# Altium schematic sheet Intel16_UNI3_Q2.SchDoc
size A3; SheetNumber: 10; SheetTotal: 15
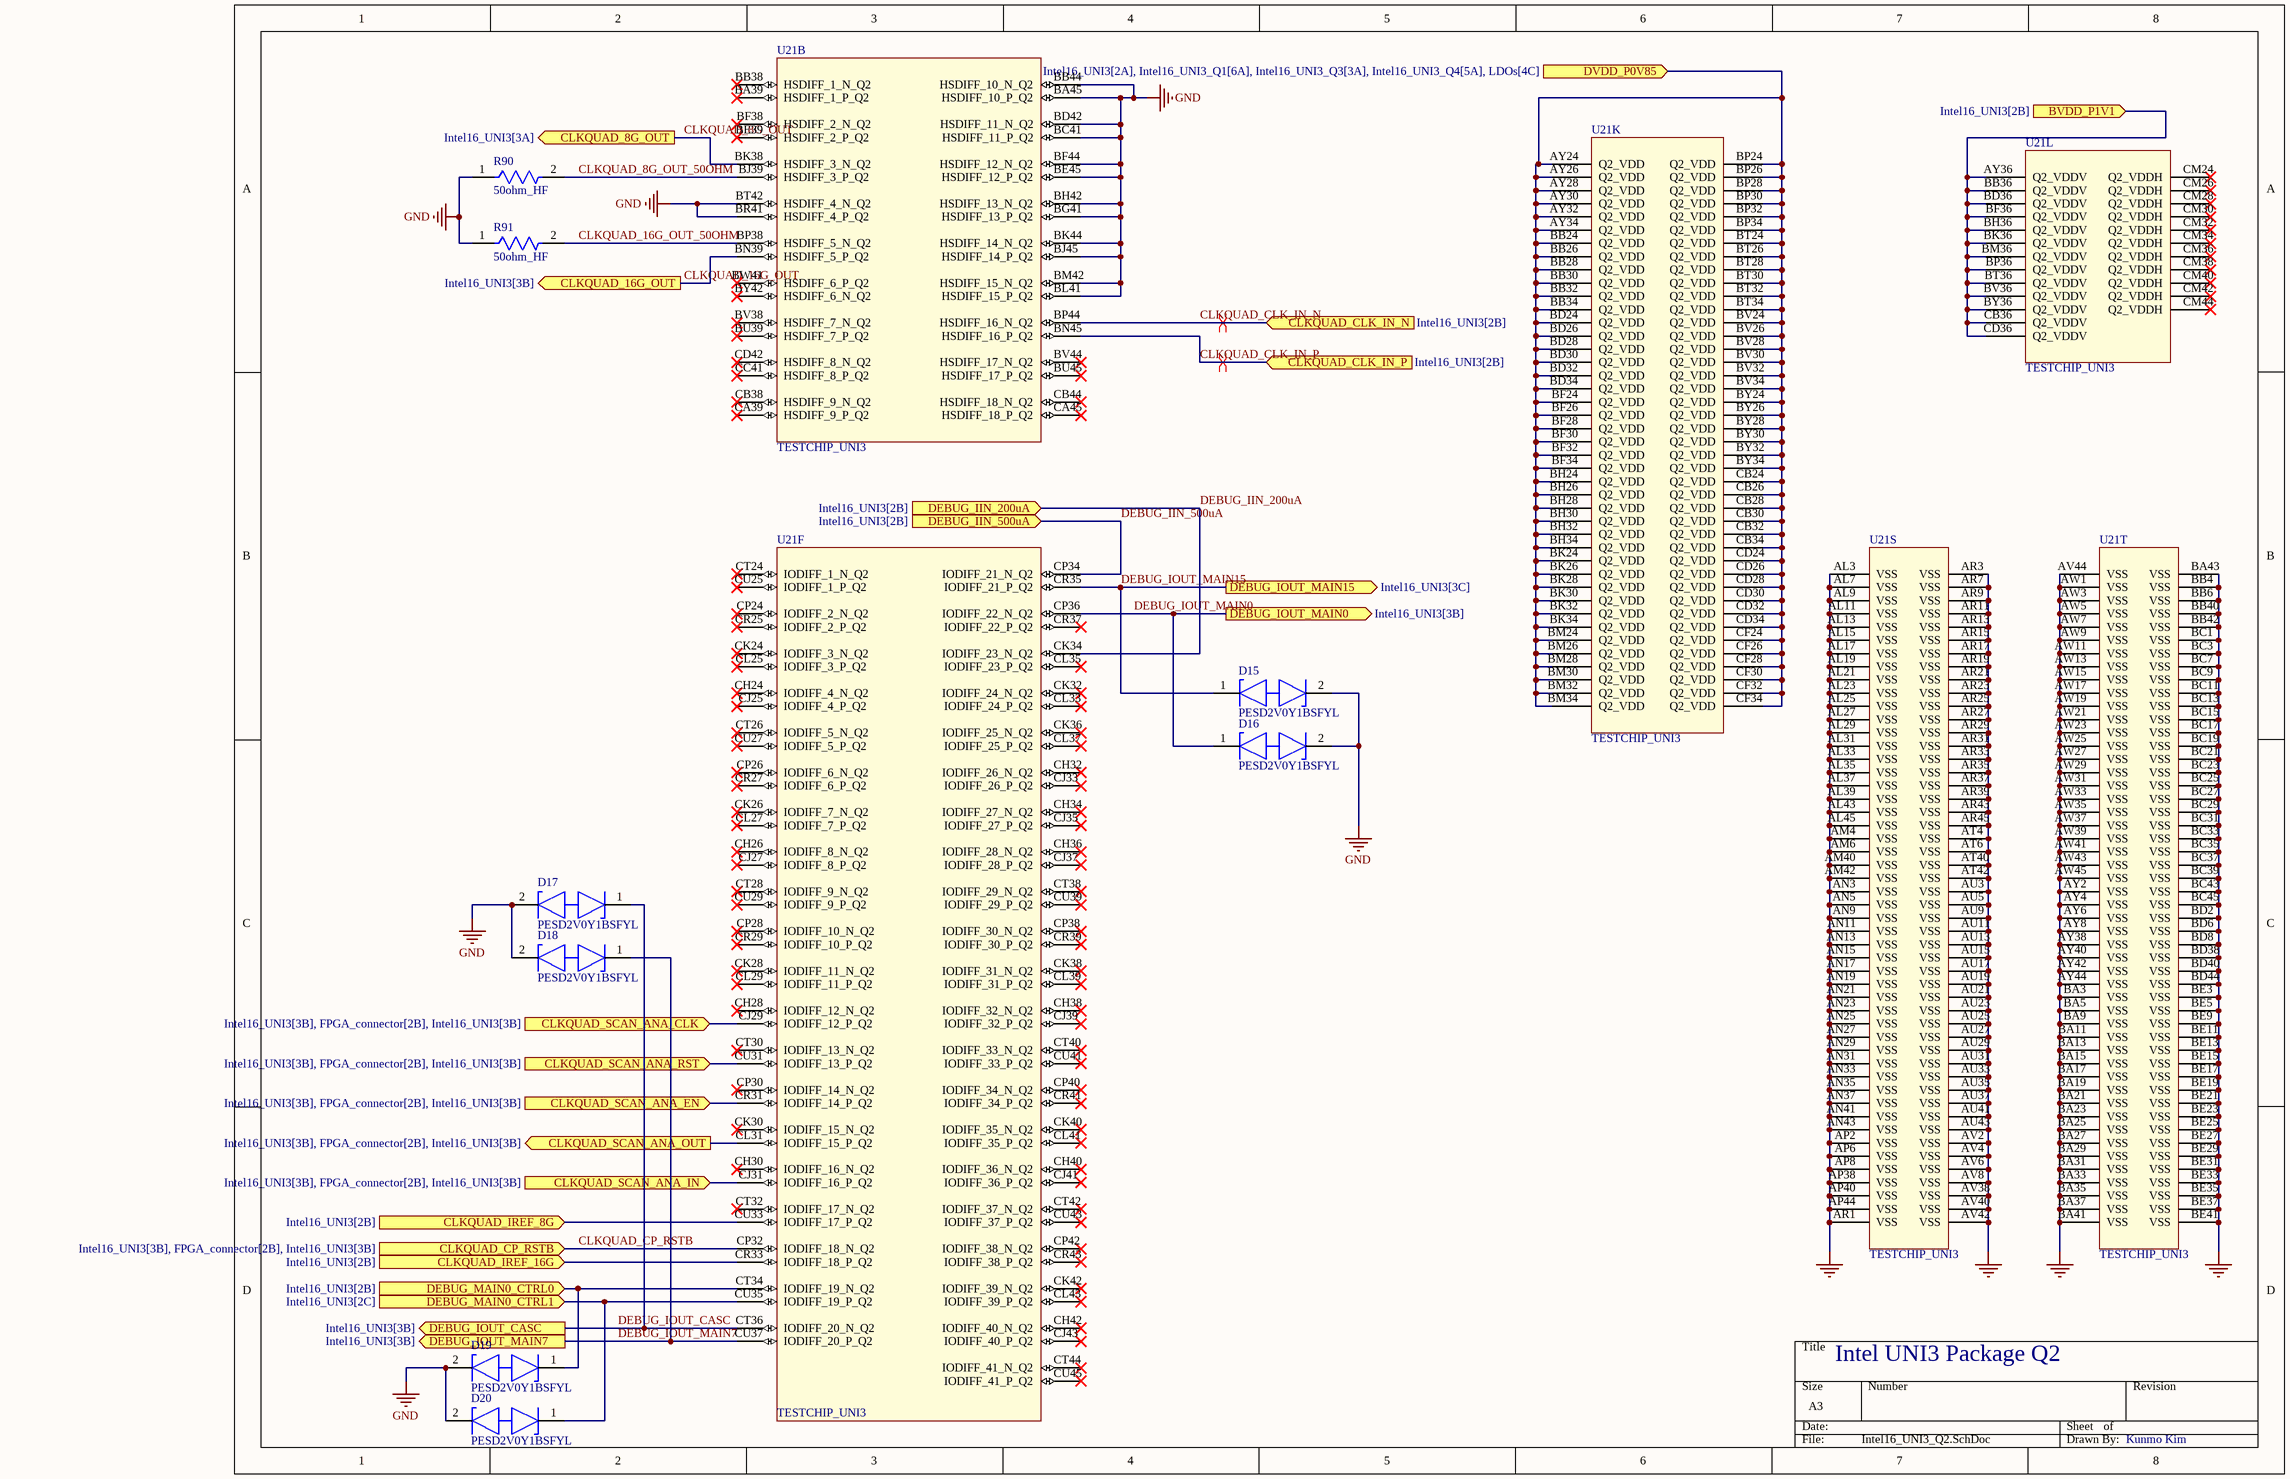
[diagram p0: Intel16_UNI3_Q2.SchDoc]

## Parts
D15  PESD2V0Y1BSFYL  [FP-SOD962-2-MFG]
D16  PESD2V0Y1BSFYL  [FP-SOD962-2-MFG]
D17  PESD2V0Y1BSFYL  [FP-SOD962-2-MFG]
D18  PESD2V0Y1BSFYL  [FP-SOD962-2-MFG]
D19  PESD2V0Y1BSFYL  [FP-SOD962-2-MFG]
D20  PESD2V0Y1BSFYL  [FP-SOD962-2-MFG]
R90  50ohm_HF  [FP-RC0100-0_15-MFG]
R91  50ohm_HF  [FP-RC0100-0_15-MFG]
U21  TESTCHIP_UNI3  [BGA-1733-.92-37.5X37.5]  (parts B,F,K,L,S,T of 25)

## Ports
BVDD_P1V1 (in, see Intel16_UNI3[2B]), CLKQUAD_8G_OUT (out, see Intel16_UNI3[3A]), CLKQUAD_16G_OUT (out, see Intel16_UNI3[3B]), CLKQUAD_CLK_IN_N (in, see Intel16_UNI3[2B]), CLKQUAD_CLK_IN_P (in, see Intel16_UNI3[2B]), CLKQUAD_CP_RSTB (in, see Intel16_UNI3[3B], FPGA_connector[2B], Intel16_UNI3[3B]), CLKQUAD_IREF_8G (in, see Intel16_UNI3[2B]), CLKQUAD_IREF_16G (in, see Intel16_UNI3[2B]), CLKQUAD_SCAN_ANA_CLK (in, see Intel16_UNI3[3B], FPGA_connector[2B], Intel16_UNI3[3B]), CLKQUAD_SCAN_ANA_EN (in, see Intel16_UNI3[3B], FPGA_connector[2B], Intel16_UNI3[3B]), CLKQUAD_SCAN_ANA_IN (in, see Intel16_UNI3[3B], FPGA_connector[2B], Intel16_UNI3[3B]), CLKQUAD_SCAN_ANA_OUT (out, see Intel16_UNI3[3B], FPGA_connector[2B], Intel16_UNI3[3B]), CLKQUAD_SCAN_ANA_RST (in, see Intel16_UNI3[3B], FPGA_connector[2B], Intel16_UNI3[3B]), DEBUG_IIN_200uA (in, see Intel16_UNI3[2B]), DEBUG_IIN_500uA (in, see Intel16_UNI3[2B]), DEBUG_IOUT_CASC (out, see Intel16_UNI3[3B]), DEBUG_IOUT_MAIN0 (out, see Intel16_UNI3[3B]), DEBUG_IOUT_MAIN7 (out, see Intel16_UNI3[3B]), DEBUG_IOUT_MAIN15 (out, see Intel16_UNI3[3C]), DEBUG_MAIN0_CTRL0 (in, see Intel16_UNI3[2B]), DEBUG_MAIN0_CTRL1 (in, see Intel16_UNI3[2C]), DVDD_P0V85 (in, see Intel16_UNI3[2A], Intel16_UNI3_Q1[6A], Intel16_UNI3_Q3[3A], Intel16_UNI3_Q4[5A], LDOs[4C])

## Nets
GND: D15.2(K2) D16.2(K2) D17.2(K2) D18.2(K2) D19.2(K2) D20.2(K2) R90.1 R91.1 U21.AL3(VSS) U21.AL7(VSS) U21.AL9(VSS) U21.AL11(VSS) U21.AL13(VSS) U21.AL15(VSS) U21.AL17(VSS) U21.AL19(VSS) U21.AL21(VSS) U21.AL23(VSS) U21.AL25(VSS) U21.AL27(VSS) U21.AL29(VSS) U21.AL31(VSS) U21.AL33(VSS) U21.AL35(VSS) U21.AL37(VSS) U21.AL39(VSS) U21.AL43(VSS) U21.AL45(VSS) U21.AM4(VSS) U21.AM6(VSS) U21.AM40(VSS) U21.AM42(VSS) U21.AN3(VSS) U21.AN5(VSS) U21.AN9(VSS) U21.AN11(VSS) U21.AN13(VSS) U21.AN15(VSS) U21.AN17(VSS) U21.AN19(VSS) U21.AN21(VSS) U21.AN23(VSS) U21.AN25(VSS) U21.AN27(VSS) U21.AN29(VSS) U21.AN31(VSS) U21.AN33(VSS) U21.AN35(VSS) U21.AN37(VSS) U21.AN41(VSS) U21.AN43(VSS) U21.AP2(VSS) U21.AP6(VSS) U21.AP8(VSS) U21.AP38(VSS) U21.AP40(VSS) U21.AP44(VSS) U21.AR1(VSS) U21.AR3(VSS) U21.AR7(VSS) U21.AR9(VSS) U21.AR11(VSS) U21.AR13(VSS) U21.AR15(VSS) U21.AR17(VSS) U21.AR19(VSS) U21.AR21(VSS) U21.AR23(VSS) U21.AR25(VSS) U21.AR27(VSS) U21.AR29(VSS) U21.AR31(VSS) U21.AR33(VSS) U21.AR35(VSS) U21.AR37(VSS) U21.AR39(VSS) U21.AR43(VSS) U21.AR45(VSS) U21.AT4(VSS) U21.AT6(VSS) U21.AT40(VSS) U21.AT42(VSS) U21.AU3(VSS) U21.AU5(VSS) U21.AU9(VSS) U21.AU11(VSS) U21.AU13(VSS) U21.AU15(VSS) U21.AU17(VSS) U21.AU19(VSS) U21.AU21(VSS) U21.AU23(VSS) U21.AU25(VSS) U21.AU27(VSS) U21.AU29(VSS) U21.AU31(VSS) U21.AU33(VSS) U21.AU35(VSS) U21.AU37(VSS) U21.AU41(VSS) U21.AU43(VSS) U21.AV2(VSS) U21.AV4(VSS) U21.AV6(VSS) U21.AV8(VSS) U21.AV38(VSS) U21.AV40(VSS) U21.AV42(VSS) U21.AV44(VSS) U21.AW1(VSS) U21.AW3(VSS) U21.AW5(VSS) U21.AW7(VSS) U21.AW9(VSS) U21.AW11(VSS) U21.AW13(VSS) U21.AW15(VSS) U21.AW17(VSS) U21.AW19(VSS) U21.AW21(VSS) U21.AW23(VSS) U21.AW25(VSS) U21.AW27(VSS) U21.AW29(VSS) U21.AW31(VSS) U21.AW33(VSS) U21.AW35(VSS) U21.AW37(VSS) U21.AW39(VSS) U21.AW41(VSS) U21.AW43(VSS) U21.AW45(VSS) U21.AY2(VSS) U21.AY4(VSS) U21.AY6(VSS) U21.AY8(VSS) U21.AY38(VSS) U21.AY40(VSS) U21.AY42(VSS) U21.AY44(VSS) U21.BA3(VSS) U21.BA5(VSS) U21.BA9(VSS) U21.BA11(VSS) U21.BA13(VSS) U21.BA15(VSS) U21.BA17(VSS) U21.BA19(VSS) U21.BA21(VSS) U21.BA23(VSS) U21.BA25(VSS) U21.BA27(VSS) U21.BA29(VSS) U21.BA31(VSS) U21.BA33(VSS) U21.BA35(VSS) U21.BA37(VSS) U21.BA41(VSS) U21.BA43(VSS) U21.BA45(HSDIFF_10_P_Q2) U21.BB4(VSS) U21.BB6(VSS) U21.BB40(VSS) U21.BB42(VSS) U21.BB44(HSDIFF_10_N_Q2) U21.BC1(VSS) U21.BC3(VSS) U21.BC7(VSS) U21.BC9(VSS) U21.BC11(VSS) U21.BC13(VSS) U21.BC15(VSS) U21.BC17(VSS) U21.BC19(VSS) U21.BC21(VSS) U21.BC23(VSS) U21.BC25(VSS) U21.BC27(VSS) U21.BC29(VSS) U21.BC31(VSS) U21.BC33(VSS) U21.BC35(VSS) U21.BC37(VSS) U21.BC39(VSS) U21.BC41(HSDIFF_11_P_Q2) U21.BC43(VSS) U21.BC45(VSS) U21.BD2(VSS) U21.BD6(VSS) U21.BD8(VSS) U21.BD38(VSS) U21.BD40(VSS) U21.BD42(HSDIFF_11_N_Q2) U21.BD44(VSS) U21.BE3(VSS) U21.BE5(VSS) U21.BE9(VSS) U21.BE11(VSS) U21.BE13(VSS) U21.BE15(VSS) U21.BE17(VSS) U21.BE19(VSS) U21.BE21(VSS) U21.BE23(VSS) U21.BE25(VSS) U21.BE27(VSS) U21.BE29(VSS) U21.BE31(VSS) U21.BE33(VSS) U21.BE35(VSS) U21.BE37(VSS) U21.BE41(VSS) U21.BE45(HSDIFF_12_P_Q2) U21.BF44(HSDIFF_12_N_Q2) U21.BG41(HSDIFF_13_P_Q2) U21.BH42(HSDIFF_13_N_Q2) U21.BJ45(HSDIFF_14_P_Q2) U21.BK44(HSDIFF_14_N_Q2) U21.BL41(HSDIFF_15_P_Q2) U21.BM42(HSDIFF_15_N_Q2) U21.BR41(HSDIFF_4_P_Q2) U21.BT42(HSDIFF_4_N_Q2)
BVDD_P1V1: U21.AY36(Q2_VDDV) U21.BB36(Q2_VDDV) U21.BD36(Q2_VDDV) U21.BF36(Q2_VDDV) U21.BH36(Q2_VDDV) U21.BK36(Q2_VDDV) U21.BM36(Q2_VDDV) U21.BP36(Q2_VDDV) U21.BT36(Q2_VDDV) U21.BV36(Q2_VDDV) U21.BY36(Q2_VDDV) U21.CB36(Q2_VDDV) U21.CD36(Q2_VDDV) ; port BVDD_P1V1
CLKQUAD_8G_OUT: U21.BK38(HSDIFF_3_N_Q2) ; port CLKQUAD_8G_OUT
CLKQUAD_8G_OUT_50OHM: R90.2 U21.BJ39(HSDIFF_3_P_Q2)
CLKQUAD_16G_OUT: U21.BN39(HSDIFF_5_P_Q2) ; port CLKQUAD_16G_OUT
CLKQUAD_16G_OUT_50OHM: R91.2 U21.BP38(HSDIFF_5_N_Q2)
CLKQUAD_CLK_IN_N: U21.BP44(HSDIFF_16_N_Q2) ; port CLKQUAD_CLK_IN_N
CLKQUAD_CLK_IN_P: U21.BN45(HSDIFF_16_P_Q2) ; port CLKQUAD_CLK_IN_P
CLKQUAD_CP_RSTB: U21.CP32(IODIFF_18_N_Q2) ; port CLKQUAD_CP_RSTB
CLKQUAD_IREF_8G: U21.CU33(IODIFF_17_P_Q2) ; port CLKQUAD_IREF_8G
CLKQUAD_IREF_16G: U21.CR33(IODIFF_18_P_Q2) ; port CLKQUAD_IREF_16G
CLKQUAD_SCAN_ANA_CLK: U21.CJ29(IODIFF_12_P_Q2) ; port CLKQUAD_SCAN_ANA_CLK
CLKQUAD_SCAN_ANA_EN: U21.CR31(IODIFF_14_P_Q2) ; port CLKQUAD_SCAN_ANA_EN
CLKQUAD_SCAN_ANA_IN: U21.CJ31(IODIFF_16_P_Q2) ; port CLKQUAD_SCAN_ANA_IN
CLKQUAD_SCAN_ANA_OUT: U21.CL31(IODIFF_15_P_Q2) ; port CLKQUAD_SCAN_ANA_OUT
CLKQUAD_SCAN_ANA_RST: U21.CU31(IODIFF_13_P_Q2) ; port CLKQUAD_SCAN_ANA_RST
DEBUG_IIN_200uA: U21.CK34(IODIFF_23_N_Q2) ; port DEBUG_IIN_200uA
DEBUG_IIN_500uA: U21.CP34(IODIFF_21_N_Q2) ; port DEBUG_IIN_500uA
DEBUG_IOUT_CASC: D17.1(K1) U21.CT36(IODIFF_20_N_Q2) ; port DEBUG_IOUT_CASC
DEBUG_IOUT_MAIN0: D16.1(K1) U21.CP36(IODIFF_22_N_Q2) ; port DEBUG_IOUT_MAIN0
DEBUG_IOUT_MAIN7: D18.1(K1) U21.CU37(IODIFF_20_P_Q2) ; port DEBUG_IOUT_MAIN7
DEBUG_IOUT_MAIN15: D15.1(K1) U21.CR35(IODIFF_21_P_Q2) ; port DEBUG_IOUT_MAIN15
DEBUG_MAIN0_CTRL0: D19.1(K1) U21.CT34(IODIFF_19_N_Q2) ; port DEBUG_MAIN0_CTRL0
DEBUG_MAIN0_CTRL1: D20.1(K1) U21.CU35(IODIFF_19_P_Q2) ; port DEBUG_MAIN0_CTRL1
DVDD_P0V85: U21.AY24(Q2_VDD) U21.AY26(Q2_VDD) U21.AY28(Q2_VDD) U21.AY30(Q2_VDD) U21.AY32(Q2_VDD) U21.AY34(Q2_VDD) U21.BB24(Q2_VDD) U21.BB26(Q2_VDD) U21.BB28(Q2_VDD) U21.BB30(Q2_VDD) U21.BB32(Q2_VDD) U21.BB34(Q2_VDD) U21.BD24(Q2_VDD) U21.BD26(Q2_VDD) U21.BD28(Q2_VDD) U21.BD30(Q2_VDD) U21.BD32(Q2_VDD) U21.BD34(Q2_VDD) U21.BF24(Q2_VDD) U21.BF26(Q2_VDD) U21.BF28(Q2_VDD) U21.BF30(Q2_VDD) U21.BF32(Q2_VDD) U21.BF34(Q2_VDD) U21.BH24(Q2_VDD) U21.BH26(Q2_VDD) U21.BH28(Q2_VDD) U21.BH30(Q2_VDD) U21.BH32(Q2_VDD) U21.BH34(Q2_VDD) U21.BK24(Q2_VDD) U21.BK26(Q2_VDD) U21.BK28(Q2_VDD) U21.BK30(Q2_VDD) U21.BK32(Q2_VDD) U21.BK34(Q2_VDD) U21.BM24(Q2_VDD) U21.BM26(Q2_VDD) U21.BM28(Q2_VDD) U21.BM30(Q2_VDD) U21.BM32(Q2_VDD) U21.BM34(Q2_VDD) U21.BP24(Q2_VDD) U21.BP26(Q2_VDD) U21.BP28(Q2_VDD) U21.BP30(Q2_VDD) U21.BP32(Q2_VDD) U21.BP34(Q2_VDD) U21.BT24(Q2_VDD) U21.BT26(Q2_VDD) U21.BT28(Q2_VDD) U21.BT30(Q2_VDD) U21.BT32(Q2_VDD) U21.BT34(Q2_VDD) U21.BV24(Q2_VDD) U21.BV26(Q2_VDD) U21.BV28(Q2_VDD) U21.BV30(Q2_VDD) U21.BV32(Q2_VDD) U21.BV34(Q2_VDD) U21.BY24(Q2_VDD) U21.BY26(Q2_VDD) U21.BY28(Q2_VDD) U21.BY30(Q2_VDD) U21.BY32(Q2_VDD) U21.BY34(Q2_VDD) U21.CB24(Q2_VDD) U21.CB26(Q2_VDD) U21.CB28(Q2_VDD) U21.CB30(Q2_VDD) U21.CB32(Q2_VDD) U21.CB34(Q2_VDD) U21.CD24(Q2_VDD) U21.CD26(Q2_VDD) U21.CD28(Q2_VDD) U21.CD30(Q2_VDD) U21.CD32(Q2_VDD) U21.CD34(Q2_VDD) U21.CF24(Q2_VDD) U21.CF26(Q2_VDD) U21.CF28(Q2_VDD) U21.CF30(Q2_VDD) U21.CF32(Q2_VDD) U21.CF34(Q2_VDD) ; port DVDD_P0V85

Not connected (* = marked no-connect by the designer): U21 BA39(HSDIFF_1_P_Q2)* BB38(HSDIFF_1_N_Q2)* BE39(HSDIFF_2_P_Q2)* BF38(HSDIFF_2_N_Q2)* BU39(HSDIFF_7_P_Q2)* BU45(HSDIFF_17_P_Q2)* BV38(HSDIFF_7_N_Q2)* BV44(HSDIFF_17_N_Q2)* BW41(HSDIFF_6_P_Q2)* BY42(HSDIFF_6_N_Q2)* CA39(HSDIFF_9_P_Q2)* CA45(HSDIFF_18_P_Q2)* CB38(HSDIFF_9_N_Q2)* CB44(HSDIFF_18_N_Q2)* CC41(HSDIFF_8_P_Q2)* CD42(HSDIFF_8_N_Q2)* CH24(IODIFF_4_N_Q2)* CH26(IODIFF_8_N_Q2)* CH28(IODIFF_12_N_Q2)* CH30(IODIFF_16_N_Q2)* CH32(IODIFF_26_N_Q2)* CH34(IODIFF_27_N_Q2)* CH36(IODIFF_28_N_Q2)* CH38(IODIFF_32_N_Q2)* CH40(IODIFF_36_N_Q2)* CH42(IODIFF_40_N_Q2)* CJ25(IODIFF_4_P_Q2)* CJ27(IODIFF_8_P_Q2)* CJ33(IODIFF_26_P_Q2)* CJ35(IODIFF_27_P_Q2)* CJ37(IODIFF_28_P_Q2)* CJ39(IODIFF_32_P_Q2)* CJ41(IODIFF_36_P_Q2)* CJ43(IODIFF_40_P_Q2)* CK24(IODIFF_3_N_Q2)* CK26(IODIFF_7_N_Q2)* CK28(IODIFF_11_N_Q2)* CK30(IODIFF_15_N_Q2)* CK32(IODIFF_24_N_Q2)* CK36(IODIFF_25_N_Q2)* CK38(IODIFF_31_N_Q2)* CK40(IODIFF_35_N_Q2)* CK42(IODIFF_39_N_Q2)* CL25(IODIFF_3_P_Q2)* CL27(IODIFF_7_P_Q2)* CL29(IODIFF_11_P_Q2)* CL33(IODIFF_24_P_Q2)* CL35(IODIFF_23_P_Q2)* CL37(IODIFF_25_P_Q2)* CL39(IODIFF_31_P_Q2)* CL41(IODIFF_35_P_Q2)* CL43(IODIFF_39_P_Q2)* CM24(Q2_VDDH)* CM26(Q2_VDDH)* CM28(Q2_VDDH)* CM30(Q2_VDDH)* CM32(Q2_VDDH)* CM34(Q2_VDDH)* CM36(Q2_VDDH)* CM38(Q2_VDDH)* CM40(Q2_VDDH)* CM42(Q2_VDDH)* CM44(Q2_VDDH)* CP24(IODIFF_2_N_Q2)* CP26(IODIFF_6_N_Q2)* CP28(IODIFF_10_N_Q2)* CP30(IODIFF_14_N_Q2)* CP38(IODIFF_30_N_Q2)* CP40(IODIFF_34_N_Q2)* CP42(IODIFF_38_N_Q2)* CR25(IODIFF_2_P_Q2)* CR27(IODIFF_6_P_Q2)* CR29(IODIFF_10_P_Q2)* CR37(IODIFF_22_P_Q2)* CR39(IODIFF_30_P_Q2)* CR41(IODIFF_34_P_Q2)* CR43(IODIFF_38_P_Q2)* CT24(IODIFF_1_N_Q2)* CT26(IODIFF_5_N_Q2)* CT28(IODIFF_9_N_Q2)* CT30(IODIFF_13_N_Q2)* CT32(IODIFF_17_N_Q2)* CT38(IODIFF_29_N_Q2)* CT40(IODIFF_33_N_Q2)* CT42(IODIFF_37_N_Q2)* CT44(IODIFF_41_N_Q2)* CU25(IODIFF_1_P_Q2)* CU27(IODIFF_5_P_Q2)* CU29(IODIFF_9_P_Q2)* CU39(IODIFF_29_P_Q2)* CU41(IODIFF_33_P_Q2)* CU43(IODIFF_37_P_Q2)* CU45(IODIFF_41_P_Q2)*

## Layout directives
differential pair: CLKQUAD_CLK_IN_N, CLKQUAD_CLK_IN_P

## Notes on the sheet
- Intel UNI3 Package Q2
- Kunmo Kim

## Library data of the parts
D15-D20 = CMP-14436-000022-1: TVS DIODE 2VWM 3VC DSN0603-2; Supplier 1: Digikey; Supplier Part Number 1: 1727-PESD2V0Y1BSFYLCT-ND
R90 R91 = yageo_50ohm: RES SMD 49.9 OHM 1% 1/32W 01005; Resistance: 113R; Max Power Dissipation: 30mW; Temperature Coefficient: 200ppm/°C; Length: 0.016inch; Resistor Type: Thick Film; Tolerance: 1%; Height: 0.006inch; RoHS Compliant: Yes; Case Code (Imperial): 1005; Width: 0.008inch; Packaging: Tape and Reel; Case Code (Metric): 0402; Min Operating Temperature: -55°C; Max Operating Temperature: 125°C; Features: Moisture Resistant; Number of Terminations: 2; Supplier 1: Digikey; Supplier Part Number 1: YAG6363CT-ND
U21 = TESTCHIP_UNI2: UNI2 interposer